# EasyEDA Pro project test_0.eprj (continued)
## Library data of the parts (continued)
U14 = ESP32-WROOM-32E-H4: 命名更改，4MB即H4，为尾缀，模组丝印更改为H4，H为高温105°C，软硬件无更改; Supplier Part: C3013935; Manufacturer: ESPRESSIF(乐鑫); Supplier Footprint: SMD,18x25.5mm; Datasheet: https://atta.szlcsc.com/upload/public/pdf/source/20220506/2B7DF1E5B41DABC7447F735C715CAF22.pdf; Supplier: LCSC
U15 = CH340C: 应用功能:收发器;接口协议:USB 2.0;数据速率:2Mbps;; LCSC Part Name: CH340C USB转串口芯片 CH340; Supplier Part: C84681; Manufacturer: WCH(南京沁恒); Supplier Footprint: SOP-16; Datasheet: https://atta.szlcsc.com/upload/public/pdf/source/20200819/C84681_ADBED554CE321879DBD6B1D06488689C.pdf; Supplier: LCSC; Applications Function: 收发器; Protocol: USB 2.0; Supply Voltage: 3.3V；5V; Data Rate: 2Mbps

## Nets
3V3: C20.2 C21.2 LED5.1(VDD) R21.2 U12.2(VOUT) U12.4(VOUT) U14.2(3V3) U15.4(V3) U15.16(VCC)
+5V: C18.2 C19.2 D2.1(C) Q2.2(S) U12.3(VIN)
GND: C11.1 C12.1 C13.1 C14.1 C15.1 C16.2 C17.1 C18.1 C19.1 C20.1 C21.1 C22.1 LED5.3(VSS) R14.1 R15.1 R16.1 R17.1 R19.2 R20.1 SW2.1 SW3.1 U8.5(CGND) U8.9(PGND) U10.2(GND) U11.2 U12.1(GND) U14.1(GND) U14.15(GND) U14.38(GND) U14.39(GND) U15.1(GND) USB1.13(GND) USB1.14(GND) USB1.15(GND) USB1.16(GND) USB1.A1B12(GND) USB1.B1A12(GND)
VBUS: D1.2(C) D3.2(A) Q1.1(G) Q2.1(G) Q3.1(G) R17.2 USB1.A4B9(VBUS) USB1.B4A9(VBUS)
VBUSIN: D3.1(C) Q3.2(S) U3.3
VCC: C17.2 D1.1(A) R18.1 U10.4(VCC)
VIN: D2.2(A) Q1.3(D) U3.2
340_D+: U15.5(D+) USB1.A6(DP1) USB1.B6(DP2)
340_D-: U15.6(D-) USB1.A7(DN1) USB1.B7(DN2)
BAT: C11.2 Q3.3(D) U10.3(BAT) U11.1
CHIP_PU: C22.2 Q4.3(C) R21.1 SW2.2 U14.3(EN)
CHRG: LED4.1(C) U10.1(CHRG#)
DTR: Q4.1(E) Q4.5(B) U15.13(DTR#)
GPIO0: Q4.6(C) SW3.2 U14.25(IO0)
RGB: LED5.4(DIN) U14.24(IO2)
RTS: Q4.2(B) Q4.4(E) U15.14(RTS#)
RXD0: U14.34(RXD0) U15.2(TXD)
STDBY: LED3.1(C) U10.5(STDBY#)
TXD0: U14.35(TXD0) U15.3(RXD)
$2N227: U8.1(LX) U8.2(LX) U9.2
$2N228: C12.2 C13.2 C14.2 Q1.2(S) R13.1 U8.3(VIN) U9.1
$2N230: R13.2 U8.4(EN)
$2N472: R14.2 U8.7(LIMI)
$2N473: R12.1 R15.2 U8.6(FB)
$2N477: C15.2 C16.1 Q2.3(D) R12.2 U8.8(VOUT)
$2N943: R19.1 USB1.A5(CC1)
$2N948: R20.2 USB1.B5(CC2)
$2N1528: R16.2 U10.6(PROG)
$2N1721: LED3.2(A) LED4.2(A) R18.2

Not connected (* = marked no-connect by the designer): LED5 2(DOUT)*; U3 1*; U14 4(SENSOR_VP)* 5(SENSOR_VN)* 6(IO34)* 7(IO35)* 8(IO32)* 9(IO33)* 10(IO25)* 11(IO26)* 12(IO27)* 13(IO14)* 14(IO12)* 16(IO13)* 17(NC)* 18(NC)* 19(NC)* 20(NC)* 21(NC)* 22(NC)* 23(IO15)* 26(IO4)* 27(IO16)* 28(IO17)* 29(IO5)* 30(IO18)* 31(IO19)* 32(NC)* 33(IO21)* 36(IO22)* 37(IO23)*; U15 7(NC.)* 8(OUT#)* 9(CTS#)* 10(DSR#)* 11(RI#)* 12(DCD#)* 15(R232)*; USB1 A8(SBU1)* B8(SBU2)*

## Notes on the sheets
sheet 2
- 充电电路
- 升压电路
- 降压电路
- 充电指示灯
- 外部电源输入
sheet 3
- 无线通信模块

# Board PCB1
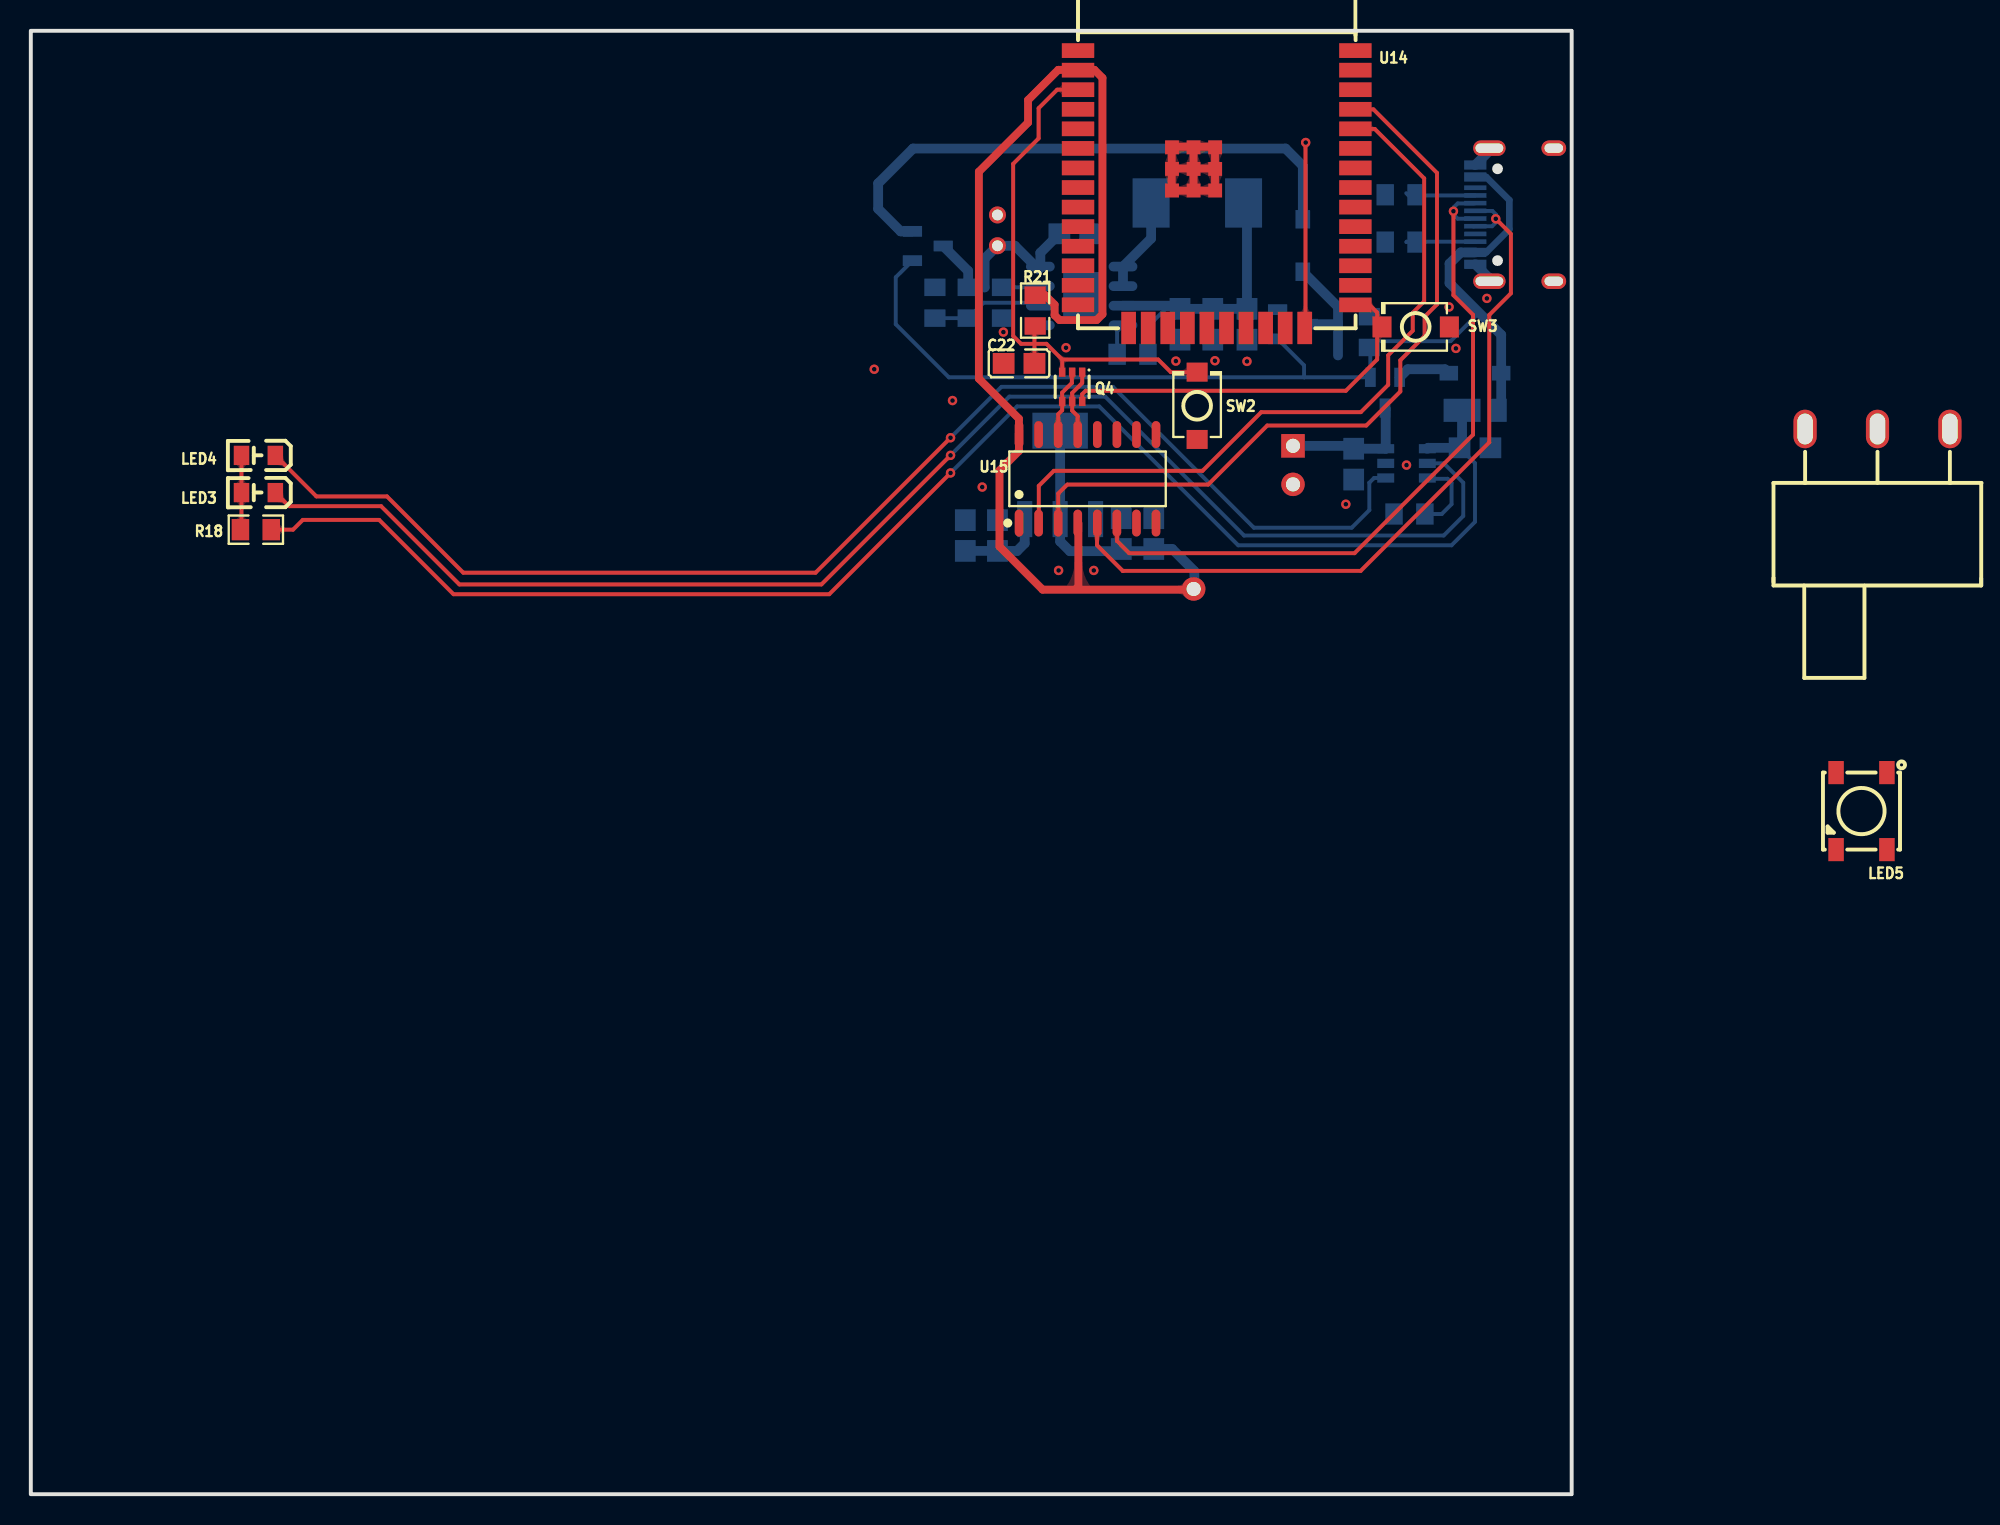
[diagram p3: board, top side]
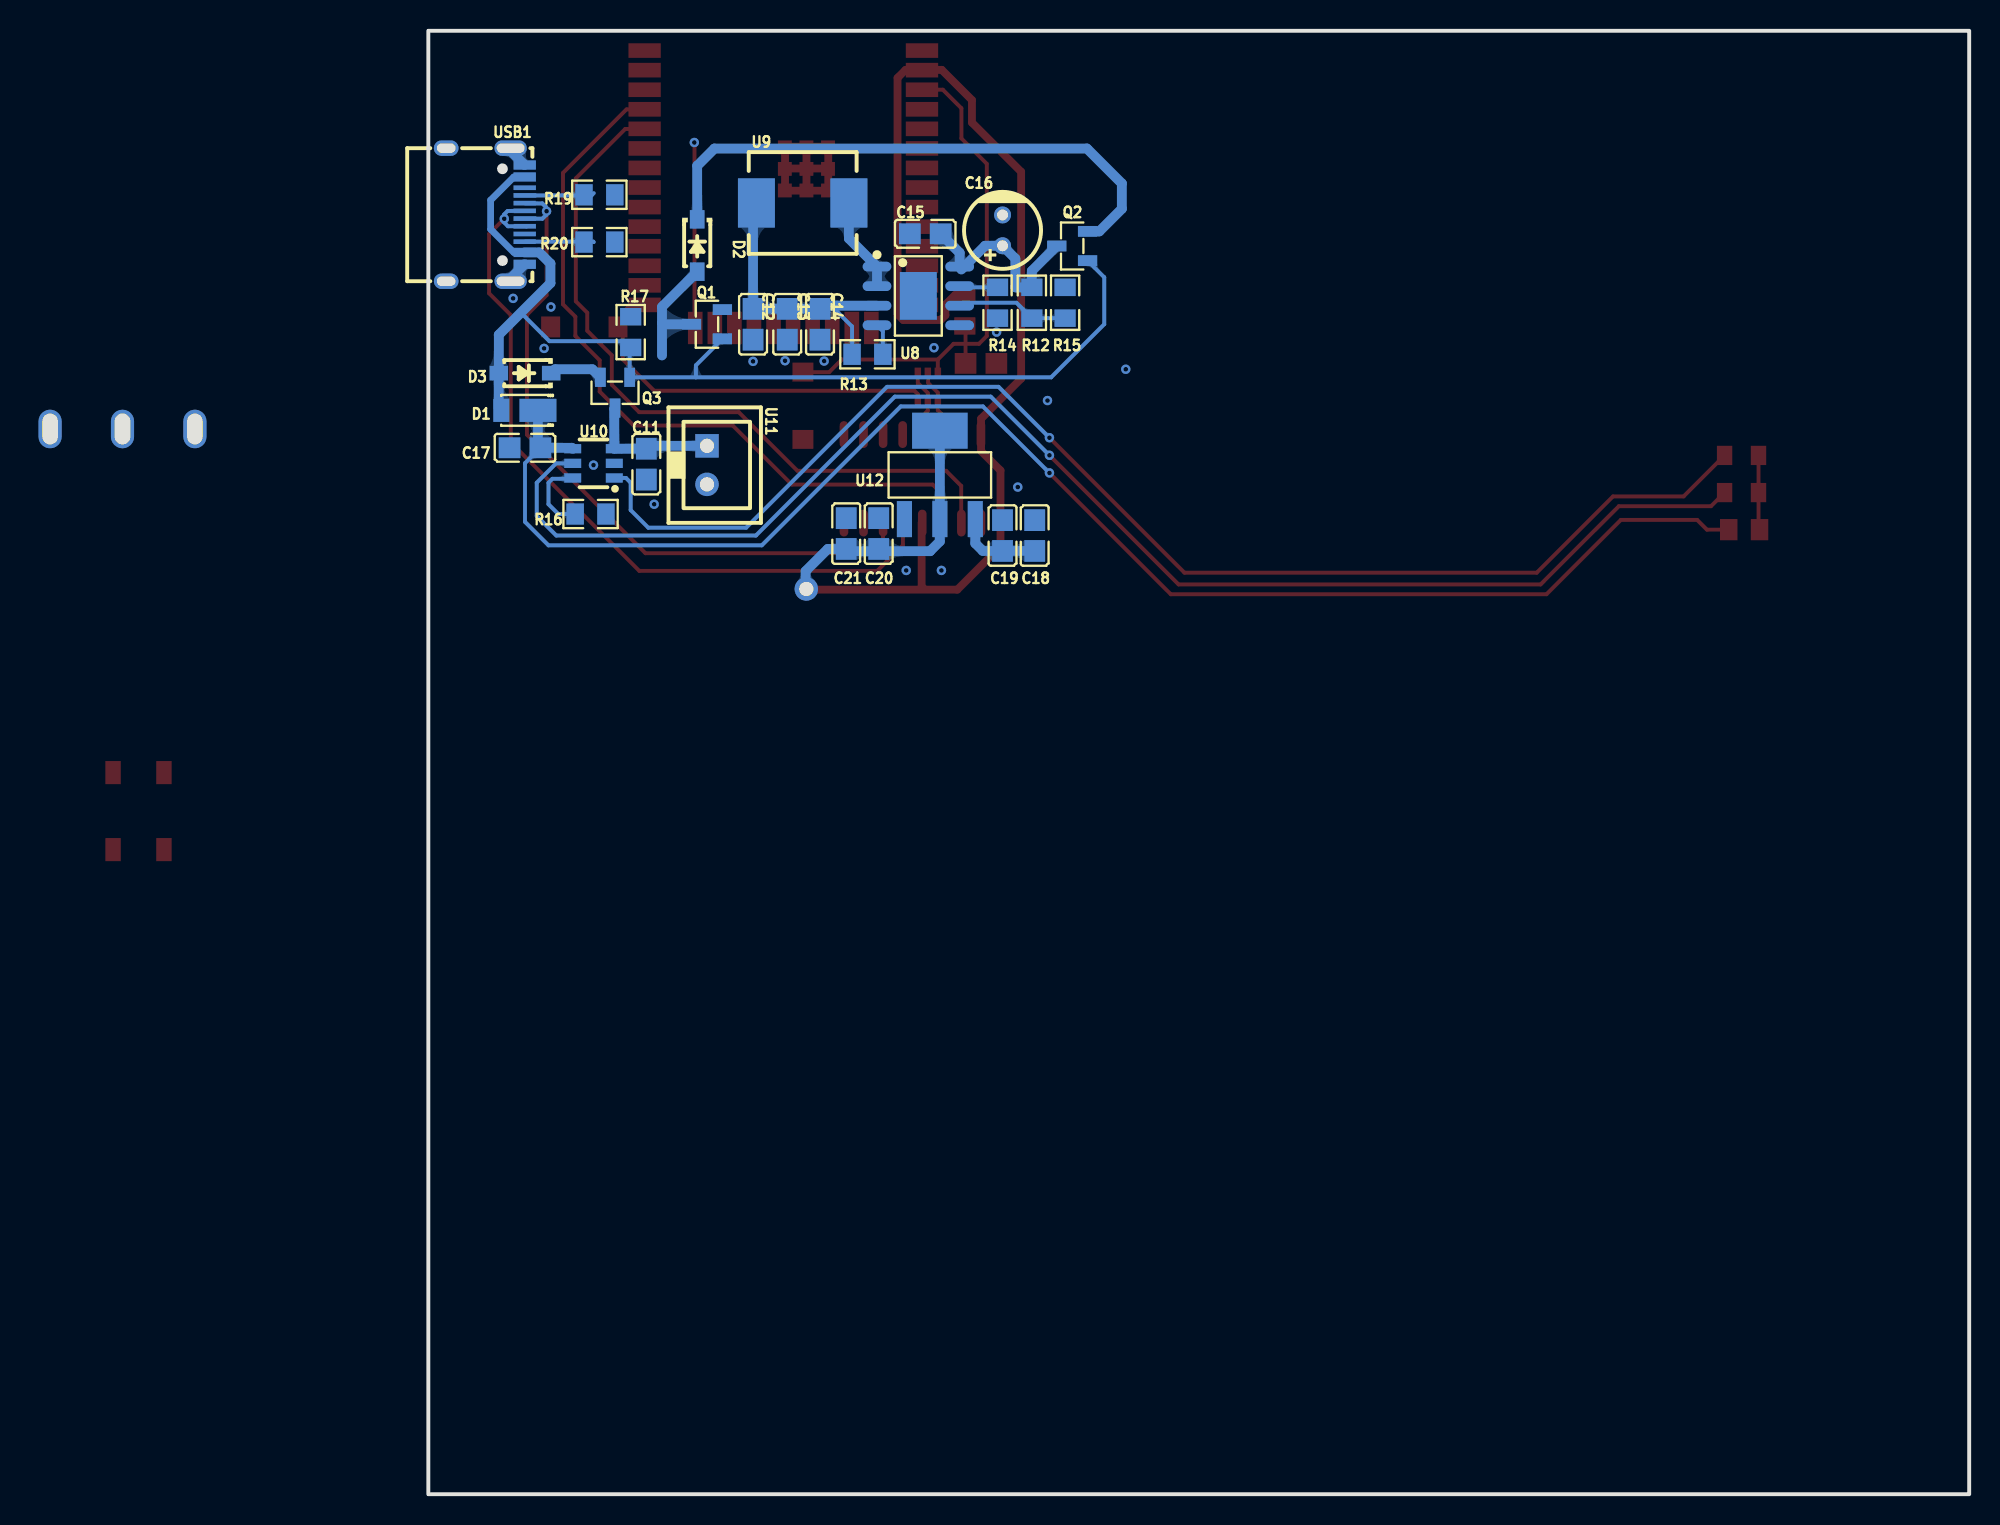
[diagram p4: board, bottom side, seen from below]

Outline 100 x 95 mm; copper layers: Top Layer, Bottom Layer. Coordinates in mm from the lower left corner of the outline.
Outline path: rectangle 0,95 100,0
Stack: Top Layer 0.035mm / Dielectric1 1.51mm FR4 er 4.5 / Bottom Layer 0.035mm

## Design rules (mm)
template: 自定义配置
spacing copperThickness1oz (default): track to track 0.102, other pairs 0.152 to 0.3
spacing copperThickness2oz: track to track 0.203, other pairs 0.152 to 0.3
track width copperThickness1oz (default): min 0.127, default 0.254, max 2.54
track width copperThickness2oz: min 0.203, default 0.254, max 2.54
differential pair differentialPair (default): width min 0.127, default 0.254, max 2.54; gap min 0.152, default 0.152
via viaSize (default): diameter min 0.5, default 0.61, max 10; hole min 0.3, default 0.305, max 6.3
net VCC uses copperRegion1
net BAT uses copperRegion1
net VBUSIN uses copperRegion1
net $2N228 uses copperRegion1
net $2N227 uses copperRegion1
net $2N477 uses copperRegion1

## Placement (name value [footprint] x y rotation side)
C11  10uF  [C0805]  85.85 66.87 90 bottom
C12  22uF  [C0805]  78.93 75.95 90 bottom
C13  22uF  [C0805]  76.71 75.95 90 bottom
C14  100nF  [C0805]  74.58 75.95 90 bottom
C15  22uF  [C0805]  67.75 81.82 180 bottom
C16  100uF  [CAP-TH_BD5.0-P2.00-D0.5-FD]  62.73 82.05 90 bottom
C17  1uF  [C0805]  93.73 67.93 180 bottom
C18  10uF  [C0805]  60.65 62.23 270 bottom
C19  100nF  [C0805]  62.73 62.23 270 bottom
C20  10uF  [C0805]  70.77 62.36 270 bottom
C21  100nF  [C0805]  72.88 62.36 270 bottom
C22  1uF  [C0805]  64.14 73.41 0 top
D1  SBR3U30P1-7  [POWERDI-123_L2.8-W1.8-LS3.7-RD-1]  94.07 70.36 0 bottom
D2  MBR0530T1G  [SOD-123_L2.7-W1.6-LS3.7-RD-1]  82.55 81.06 270 bottom
D3  MBR0530T1G  [SOD-123_L2.7-W1.6-LS3.7-RD-1]  93.73 72.77 0 bottom
LED3  -  [LED_0805]  14.72 65.03 180 top
LED4  -  [LED_0805]  14.72 67.44 180 top
LED5  WS2812B-B  [LED-SMD_4P-L5.0-W5.0-BL_TC5050RGB]  118.81 44.35 270 top
NOREF  -  [Pad_e39]  75.47 58.77 0 top
Q1  -  [SOT-23-3_L2.9-W1.3-P1.90-LS2.4-BR]  81.92 75.95 180 bottom
Q2  -  [SOT-23-3_L2.9-W1.3-P1.90-LS2.4-BR]  58.21 81.03 180 bottom
Q3  -  [SOT-23-3_L2.9-W1.3-P1.90-LS2.4-BR]  87.88 71.5 90 bottom
Q4  UMH3N  [SC-70-6_L2.2-W1.3-P0.65-LS2.1-BR]  67.58 71.89 90 top
R12  73K  [R0805]  60.83 77.35 90 bottom
R13  1K  [R0805]  71.5 74 180 bottom
R14  30K  [R0805]  63.06 77.35 90 bottom
R15  10K  [R0805]  58.67 77.35 270 bottom
R16  10K  [R0805]  89.47 63.63 0 bottom
R17  100K  [R0805]  86.87 75.44 270 bottom
R18  1K  [R0805]  14.6 62.61 180 top
R19  5.1k  [R0805]  88.9 84.36 180 bottom
R20  5.1k  [R0805]  88.9 81.28 0 bottom
R21  10K  [R0805]  65.18 76.84 90 top
SW2  TS-1088-AR02016  [SW-SMD_L3.9-W3.0-P4.45]  75.69 70.66 90 top
SW3  TS-1088-AR02016  [SW-SMD_L3.9-W3.0-P4.45]  89.88 75.78 180 top
U3  KH-SS12D11-G5  [SW-TH_KH-SS12D11-G5]  119.85 64.9 0 top
U8  -  [ESOP-8_L4.9-W3.9-P1.27-LS6.0-BL-EP3.1-1]  68.2 77.79 270 bottom
U9  3.3uH  [IND-SMD_L7.0-W6.6]  75.71 83.82 180 bottom
U10  TP4057  [SOT-23-6_L2.9-W1.6-P0.95-LS2.8-BR]  89.28 66.92 180 bottom
U11  BX-XH2.54-2PZZ  [CONN-TH_2P-P2.50_BX-XH2.54-2PZZ]  81.92 66.81 270 bottom
U12  AMS1117-3.3  [SOT-223-3_L6.7-W3.7-P2.30-LS7.0-BR]  66.8 66.17 270 bottom
U14  ESP32-WROOM-32E-H4  [WIFI-SMD_ESP32-WROOM-32E]  76.96 84.71 270 top
U15  CH340C  [SOP-16_L10.0-W3.9-P1.27-LS6.0-BL]  68.58 65.92 0 top
USB1  TYPEC-304-BCP16  [USB-C-SMD_TYPEC-304-BCP16]  96.29 83.06 270 bottom

## Footprints (pads in the part's own frame, mm; a bottom-side part is the same pattern mirrored in y, then rotated)
C0805
  rect 1.41x1.35 smd: 1(-1,0) 2(1,0)
CAP-TH_BD5.0-P2.00-D0.5-FD
  round 1.1 hole 0.7: 1(-1,0) 2(1,0)
CONN-TH_2P-P2.50_BX-XH2.54-2PZZ
  rect 1.524x1.524 hole 0.914: 1(-1.25,0)
  round 1.524 hole 0.914: 2(1.25,0)
ESOP-8_L4.9-W3.9-P1.27-LS6.0-BL-EP3.1-1
  oval 0.63x1.865 smd: 1(-1.905,-2.683) 2(-0.635,-2.683) 3(0.635,-2.683) 4(1.905,-2.683) 5(1.905,2.683) 6(0.635,2.683) 7(-0.635,2.683) 8(-1.905,2.683)
  rect 3.1x2.4 smd: 9(0,0)
IND-SMD_L7.0-W6.6
  rect 2.4x3.2 smd: 1(-3,0) 2(3,0)
LED-SMD_4P-L5.0-W5.0-BL_TC5050RGB
  rect 1.5x1 smd: 1(-2.5,1.65) 2(-2.5,-1.65) 3(2.5,-1.65) 4(2.5,1.65)
LED_0805
  rect 1x1.25 smd: 1(-1.15,0.005) 2(1.05,0.005)
Pad_e39
  round 1.524 hole 0.914: 42(0,0)
POWERDI-123_L2.8-W1.8-LS3.7-RD-1
  rect 2.4x1.5 smd: 1(-1.188,0)
  rect 1.05x1.5 smd: 2(1.188,0)
R0805
  rect 1.133x1.377 smd: 1(-1,0) 2(1,0)
SC-70-6_L2.2-W1.3-P0.65-LS2.1-BR
  rect 0.6x0.42 smd: 1(0.95,-0.65) 2(0.95,0) 3(0.95,0.65) 4(-0.95,0.65) 5(-0.95,0) 6(-0.95,-0.65)
SOD-123_L2.7-W1.6-LS3.7-RD-1
  rect 1.2x0.95 smd: 1(-1.7,0) 2(1.7,0)
SOP-16_L10.0-W3.9-P1.27-LS6.0-BL
  oval 0.56x1.745 smd: 1(-4.445,-2.873) 2(-3.175,-2.873) 3(-1.905,-2.873) 4(-0.635,-2.873) 5(0.635,-2.873) 6(1.905,-2.873) 7(3.175,-2.873) 8(4.445,-2.873) 9(4.445,2.873) 10(3.175,2.873) 11(1.905,2.873) 12(0.635,2.873) 13(-0.635,2.873) 14(-1.905,2.873) 15(-3.175,2.873) 16(-4.445,2.873)
SOT-23-3_L2.9-W1.3-P1.90-LS2.4-BR
  rect 1.25x0.7 smd: 1(1,-0.95) 2(1,0.95) 3(-1,0)
SOT-23-6_L2.9-W1.6-P0.95-LS2.8-BR
  rect 1.1x0.6 smd: 1(1.35,-0.95) 2(1.35,0) 3(1.35,0.95) 4(-1.35,0.95) 5(-1.35,0) 6(-1.35,-0.95)
SOT-223-3_L6.7-W3.7-P2.30-LS7.0-BR
  rect 2.34x0.98 smd: 1(2.87,-2.3) 2(2.87,0) 3(2.87,2.3)
  rect 2.34x3.6 smd: 4(-2.87,0)
SW-SMD_L3.9-W3.0-P4.45
  rect 1.23x1.36 smd: 1(-2.185,0) 2(2.185,0)
SW-TH_KH-SS12D11-G5
  oval 1.5x2.5 hole 1x2: 1(-4.7,4.25) 2(0,4.25) 3(4.7,4.25)
USB-C-SMD_TYPEC-304-BCP16
  oval 1x2.1 hole 0.6x1.8: 13(-4.32,1.633) 14(4.32,1.633)
  oval 1x1.6 hole 0.6x1.2: 15(-4.32,-2.547) 16(4.32,-2.547)
  rect 0.6x1.45 smd: A1B12(-3.225,2.547) A4B9(-2.45,2.547) B1A12(3.22,2.547) B4A9(2.45,2.547)
  rect 0.3x1.45 smd: A5(-1.25,2.547) A6(-0.25,2.547) A7(0.25,2.547) A8(1.25,2.547) B5(1.75,2.547) B6(0.75,2.547) B7(-0.75,2.547) B8(-1.75,2.547)
WIFI-SMD_ESP32-WROOM-32E
  rect 0.95x2.1 smd: 1(-9.002,-9) 2(-7.732,-9) 3(-6.463,-9) 4(-5.192,-9) 5(-3.922,-9) 6(-2.652,-9) 7(-1.383,-9) 8(-0.113,-9) 9(1.157,-9) 10(2.428,-9) 11(3.697,-9) 12(4.968,-9) 13(6.237,-9) 14(7.508,-9) 25(7.508,9) 26(6.237,9) 27(4.968,9) 28(3.697,9) 29(2.428,9) 30(1.157,9) 31(-0.113,9) 32(-1.383,9) 33(-2.652,9) 34(-3.922,9) 35(-5.192,9) 36(-6.463,9) 37(-7.732,9) 38(-9.002,9)
  rect 2.1x0.95 smd: 15(9.002,-5.715) 16(9.002,-4.445) 17(9.002,-3.175) 18(9.002,-1.905) 19(9.002,-0.635) 20(9.002,0.635) 21(9.002,1.905) 22(9.002,3.175) 23(9.002,4.445) 24(9.002,5.715)
  rect 0.9x0.9 smd: 39(-2.721,-0.1) 39(-2.721,-1.5) 39(-2.721,-2.9) 39(-1.321,-0.1) 39(-1.321,-1.5) 39(-1.321,-2.9) 39(0.079,-0.1) 39(0.079,-1.5) 39(0.079,-2.9)

## Nets
As in the schematic, except:
3V3: C20.2 C21.2 LED5.1 NOREF.42 R21.2 U12.2 U12.4 U14.2 U15.4 U15.16

Pads without a net: LED5 2; U3 1; U14 4 5 6 7 8 9 10 11 12 13 14 16 17 18 19 20 21 22 23 26 27 28 29 30 31 32 33 36 37; U15 7 8 9 10 11 12 15; USB1 A8 B8

## Via types
v1: diameter 0.61, hole 0.305, Top Layer to Bottom Layer, 21 vias

## Routing (per net, layer and track width the routed paths; a pad name or vN(x,y) marks a point on that pad's centre or on a via; arc(x,y) is an arc through that point)
3V3: length 94.8
  Top Layer w0.508: 75.48,58.72 65.67,58.72 62.87,61.52 62.87,66.46 64.13,67.72 64.13,69.82 61.53,72.42 61.53,85.85 64.72,89.04 64.72,90.51 66.68,92.46 69.03,92.46 69.55,91.94 69.55,76.6 69.17,76.22 66.76,76.22 66.44,76.54 66.44,77.22 65.81,77.85 65.12,77.85 ; 67.99,63.04 67.99,58.93 67.85,58.79
  Bottom Layer w0.635: 75.51,58.83 75.51,59.92 74.08,61.36 C21.2 72.74,61.22 67.44,61.22 66.8,61.85 U12.2 U12.4
+5V: length 42.5
  Bottom Layer w0.635: D2.1 82.55,86.24 81.43,87.36 57.25,87.36 54.99,85.09 54.99,83.44 56.45,81.98 Q2.2 ; C18.2 C19.2 64.01,61.23 64.5,61.73 U12.3
GND: length 20.3
  Top Layer w0.508: 74.05,86.06 75.46,86.06 ; 74.05,86.06 74.01,86.06 ; 74.05,86.06 74.05,84.62 ; 74.05,86.06 74.05,87.47 ; 75.46,86.06 76.85,86.06 ; 75.46,86.06 75.46,84.62 ; 75.46,86.06 75.46,87.47 ; 73.98,84.53 74.05,84.6 74.05,84.62 ; 74.05,84.62 73.96,84.62 ; 74.05,84.62 75.46,84.62 ; 75.46,84.62 75.46,84.58 75.44,84.56 ; 76.85,86.06 76.85,87.45 ; 76.85,86.06 76.85,84.7 ; 76.85,86.06 76.89,86.06 76.91,86.08 ; 74.05,87.47 74.03,87.5 ; 74.05,87.47 75.46,87.47 ; 76.85,84.7 76.89,84.73 ; 76.85,84.7 76.77,84.62 75.46,84.62 ; 75.46,87.47 75.46,87.49 ; 75.46,87.47 76.85,87.47
  Bottom Layer w0.635: USB1.14 94.66,78.93 USB1.B1A12 ; USB1.A1B12 94.66,87.2 USB1.13
  vias: v1(54.74,73.03) v1(59.82,71) v1(61.75,65.38) v1(63.12,75.44) v1(66.7,59.97) v1(67.18,74.43) v1(68.99,59.97) v1(74.31,73.56) v1(76.85,73.58) v1(78.93,73.54) v1(85.34,64.27) v1(89.28,66.81) v1(92.05,77.07) v1(92.49,74.38) v1(94.5,77.63)
VBUS: length 70.5
  Bottom Layer w0.254: Q1.1 82.63,73.28 82.63,72.51 82.64,72.5 ; 86.93,74.38 Q3.1 82.64,72.5 ; 86.93,74.38 R17.2 ; 86.93,74.38 87.41,74.85 92.14,74.85 93.94,76.65 93.94,76.75 ; 82.64,72.5 59.58,72.5 56.13,75.95 56.13,79 Q2.1
  Bottom Layer w0.432: USB1.A4B9 94.45,85.51 95.96,84.01 95.96,82.12 94.45,80.61 USB1.B4A9
  Bottom Layer w0.635: USB1.B4A9 92.8,80.61 92.08,79.89 92.08,78.62 95.43,75.27 D3.2 95.43,70.53 D1.2
VBUSIN: length 3.5
  Bottom Layer w0.635: Q3.2 89.36,73.03 91.77,73.03 D3.1
VCC: length 99.6
  Top Layer w0.254: R18.1 17.02,62.61 17.65,63.25 22.61,63.25 27.43,58.42 51.82,58.42 v1(59.69,66.3)
  Bottom Layer w0.254: C17.2 93.73,66.93 93.73,63.12 92.2,61.6 78.36,61.6 69.34,70.62 64.01,70.62 v1(59.69,66.3)
  Bottom Layer w0.635: D1.1 92.89,68.09 C17.2 90.69,67.93 U10.4
VIN: length 8.3
  Bottom Layer w0.635: D2.2 84.84,77.08 84.84,76.03 ; 84.84,76.03 84.84,73.93 ; 84.84,76.03 84.76,75.95 Q1.3
340_D+: length 50.1
  Top Layer w0.254: 69.2,63.04 69.2,61.61 70.86,59.94 ; 94.65,68.28 86.31,59.94 70.88,59.94 70.87,59.93 ; v1(95.07,82.8) 96.05,81.82 96.05,77.96 94.65,76.55 94.65,68.28
  Bottom Layer w0.254: 93.74,83.31 94.85,83.31 95.09,83.07 95.09,82.56 94.83,82.31 93.65,82.31 93.64,82.29
340_D-: length 45.9
  Top Layer w0.254: 70.49,63.04 70.49,61.88 71.29,61.09 85.91,61.09 93.6,68.78 93.6,76.56 92.33,77.83 v1(92.33,83.29)
  Bottom Layer w0.254: 93.7,83.79 92.6,83.79 92.35,83.54 92.35,83.05 92.6,82.8 93.42,82.8
BAT: length 8.7
  Bottom Layer w0.635: Q3.3 87.93,70.46 U10.3 C11.2 85.67,68.06 U11.1
CHIP_PU: length 34.7
  Top Layer w0.254: 66.93,73.66 65.91,74.68 65.14,74.68 ; 66.93,73.66 Q4.3 ; 66.93,73.66 73.17,73.66 73.99,72.84 75.7,72.84 ; 65.14,74.68 65.14,75.79 R21.1 ; 65.14,74.68 C22.2 ; 65.14,74.68 64.26,74.68 63.75,75.19 63.75,86.36 65.4,88.01 65.4,89.97 66.61,91.18 U14.3
CHRG: length 86.4
  Top Layer w0.254: v1(59.69,68.58) 50.93,59.82 28.07,59.82 23.11,64.77 18.53,64.77 LED4.1
  Bottom Layer w0.254: v1(59.69,68.58) 62.99,71.89 70.23,71.89 79.37,62.74 85.73,62.74 86.87,63.88 86.87,65.66 87.17,65.97 U10.1
DTR: length 4.5
  Top Layer w0.254: Q4.1 68.23,72.14 67.58,71.49 Q4.5 67.58,70.34 67.95,69.98 U15.13
GPIO0: length 25.2
  Top Layer w0.254: U14.25 86.88,77.21 87.38,76.71 87.38,73.66 85.34,71.63 68.45,71.63 68.23,71.41 Q4.6
RGB: length 12
  Top Layer w0.254: 82.66,75.76 82.73,75.82 82.73,87.74 v1(82.74,87.75)
RTS: length 4.4
  Top Layer w0.254: Q4.2 67.56,72.82 67.56,72.14 66.93,71.51 Q4.4 66.93,70.37 66.67,70.11 U15.14
RXD0: length 48
  Top Layer w0.254: 65.42,63.02 65.42,65.46 66.39,66.43 76.04,66.43 79.85,70.24 86.32,70.24 88.09,72.02 88.09,73.94 89.69,75.53 89.69,76.7 90.43,77.44 90.43,85.42 87.22,88.63 85.98,88.63
STDBY: length 93.9
  Top Layer w0.254: LED3.1 16.76,64.14 22.73,64.14 27.81,59.06 51.31,59.06 v1(59.69,67.44)
  Bottom Layer w0.254: v1(59.69,67.44) 63.5,71.25 69.72,71.25 78.74,62.23 91.69,62.23 92.96,63.5 92.96,65.66 91.71,66.92 U10.5
TXD0: length 49
  Top Layer w0.254: 66.58,63.11 66.68,63.21 66.68,64.95 67.27,65.54 76.41,65.54 80.24,69.38 86.67,69.38 88.88,71.58 88.88,73.61 90.46,75.19 90.46,76.44 91.26,77.24 91.26,85.77 87.13,89.9 85.96,89.9
$2N227: length 6.2
  Bottom Layer w0.635: U8.2 U8.1 72.71,81.52 U9.2
$2N228: length 19.5
  Bottom Layer w0.254: R13.1 72.5,75.81 73.64,76.95 C14.2
  Bottom Layer w0.635: U8.3 74.38,77.15 C14.2 C13.2 C12.2 78.93,83.6 U9.1
$2N230: length 2
  Bottom Layer w0.254: R13.2 70.5,75.5 U8.4
$2N472: length 2.5
  Bottom Layer w0.254: U8.7 65.44,78.35 R14.2
$2N473: length 7.3
  Bottom Layer w0.254: U8.6 65.32,77.35 61.83,77.35 R12.1 R15.2
$2N477: length 13.4
  Bottom Layer w0.635: U8.8 65.52,80.59 C15.2 ; 65.4,79.51 63.86,81.05 C16.1 61.9,80.21 61.9,78.35 R12.2 60.83,79.41 Q2.3
$2N943: length 4.5
  Bottom Layer w0.254: 89.27,84.46 89.41,84.31 93.74,84.31
$2N948: length 4.5
  Bottom Layer w0.254: 89.27,81.28 89.29,81.31 93.74,81.31
$2N1528: length 5.1
  Bottom Layer w0.254: R16.2 91.57,63.63 92.2,64.27 92.2,65.66 91.95,65.92 90.68,65.92 U10.6
$2N1721: length 4.8
  Top Layer w0.254: LED4.2 LED3.2 13.67,62.68 R18.2

## Copper pours and planes (outline as drawn; the poured copper is in the pictures)
GND on Top Layer: -0.21,94.89 99.79,94.89 99.79,-0.09 -0.21,-0.09
GND on Bottom Layer: 0,95.02 100,95.02 100,0.04 0,0.04
VBUSIN on Bottom Layer: 88.52,73.03 89.41,73.92 91.57,73.92 92.46,73.03 92.46,72.02 91.95,71.51 89.15,71.51 88.52,72.14
VCC on Bottom Layer: 90.3,67.03 93.19,67.03 93.73,67.56 93.73,69.23 91.82,71.01 89.79,69.12 89.79,67.54
BAT on Bottom Layer: 79.88,69.09 79.88,67.44 80.52,66.81 86.74,66.81 87.25,67.31 88.64,67.31 89.28,67.95 89.28,70.55 88.31,71.52 82.31,71.52
$2N227 on Bottom Layer: 71.76,85.86 74.63,85.86 75.71,84.78 75.71,79.96 73.4,77.65 70.24,77.65 69.72,78.17 69.72,80.01 70.99,81.28 70.99,85.09
$2N228 on Bottom Layer: 79.76,85.86 80.39,85.22 80.39,79.25 81.53,78.11 81.53,76.54 80.94,75.95 72.14,75.95 71.63,76.46 70.23,76.46 69.98,76.71 69.98,77.35 70.36,77.73 73.53,77.73 75.95,80.14 75.95,84.71 77.09,85.86
$2N477 on Bottom Layer: 66.67,83.32 67.75,82.24 67.75,80.58 66.29,79.12 62.42,79.12 61.12,77.82 60.11,77.82 59.59,78.34 59.59,79.08 58.2,80.47 58.2,81.3 58.94,82.04 64.26,82.04 65.53,83.32

Small or netless copper shapes (teardrops, artwork), in the pictures only: 69 on Top Layer, 92 on Bottom Layer
